# EasyEDA Pro project FOX_HTOL_1.0.eprj, board PCB1 (continued)
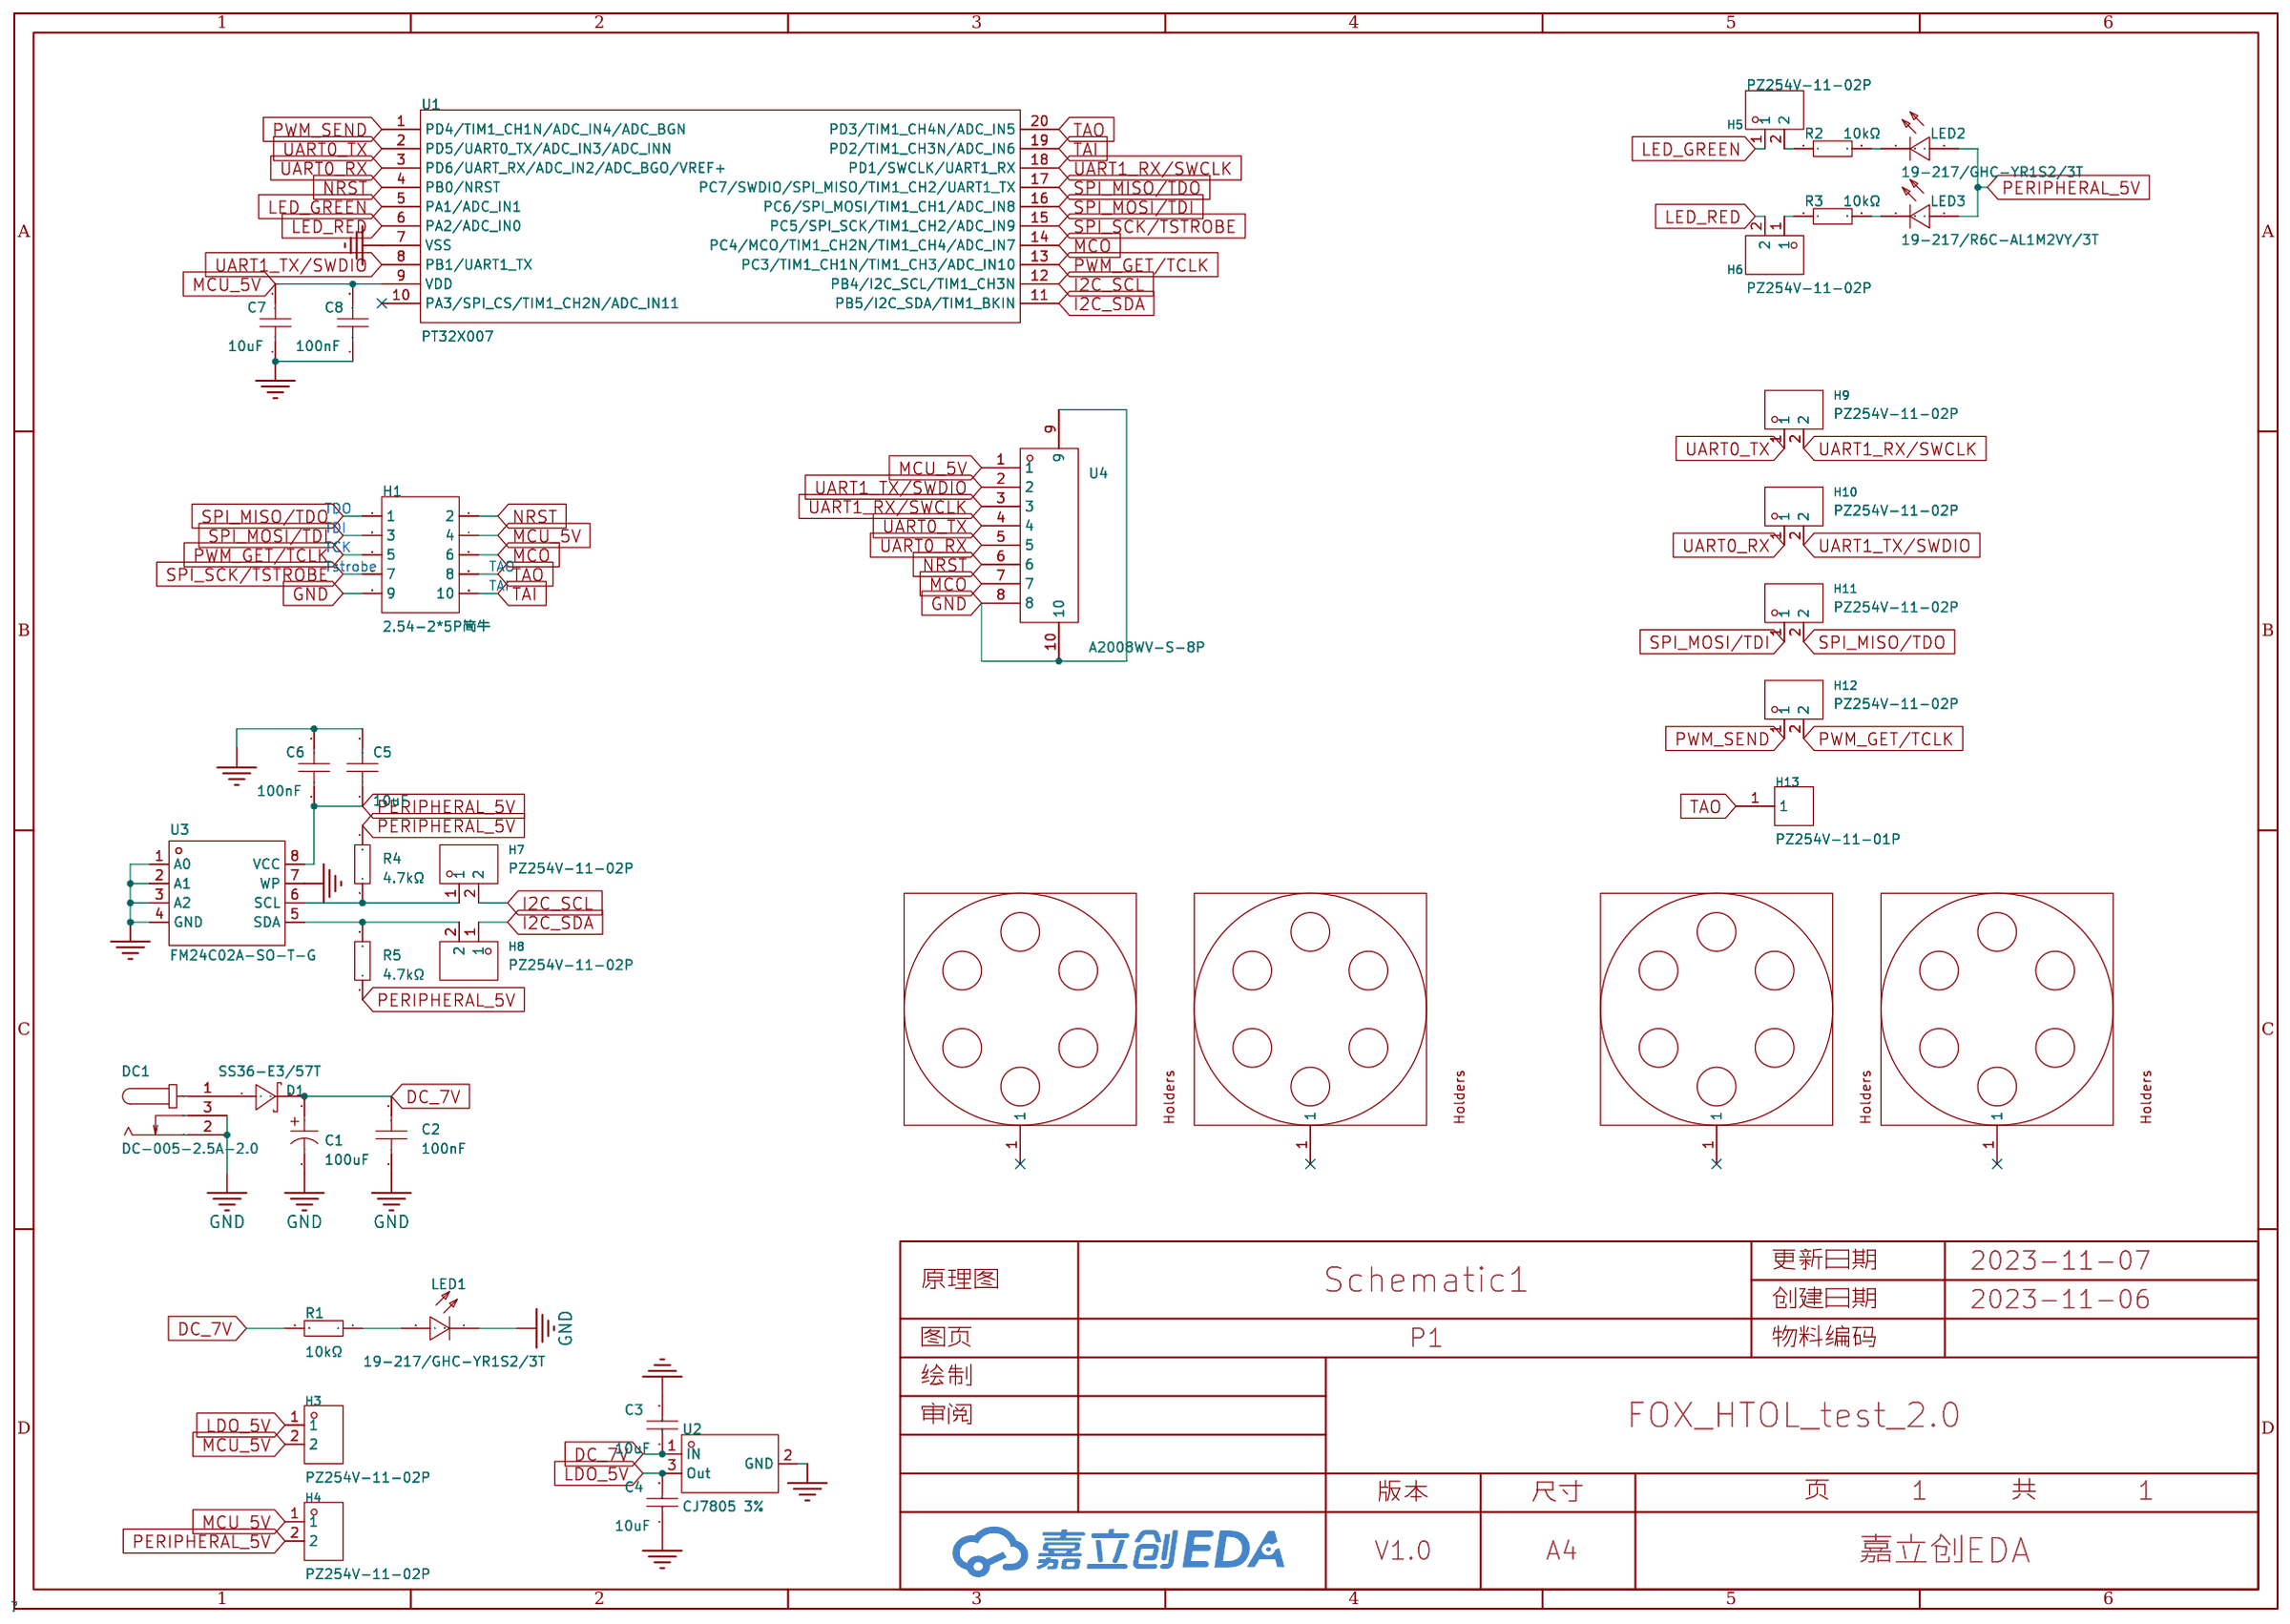
[diagram p0: schematic sheet]
## Nets (continued)
MCU_5V: C7.2 C7#2.2 C7#3.2 C7#4.2 C7#5.2 C7#6.2 C7#7.2 C7#8.2 C7#9.2 C7#10.2 C7#11.2 C7#12.2 C7#13.2 C7#14.2 C7#15.2 C7#16.2 C7#17.2 C7#18.2 C7#19.2 C7#20.2 C7#21.2 C7#22.2 C7#23.2 C7#24.2 C7#25.2 C7#26.2 C7#27.2 C7#28.2 C7#29.2 C7#30.2 C7#31.2 C7#32.2 C8.2 C8#2.2 C8#3.2 C8#4.2 C8#5.2 C8#6.2 C8#7.2 C8#8.2 C8#9.2 C8#10.2 C8#11.2 C8#12.2 C8#13.2 C8#14.2 C8#15.2 C8#16.2 C8#17.2 C8#18.2 C8#19.2 C8#20.2 C8#21.2 C8#22.2 C8#23.2 C8#24.2 C8#25.2 C8#26.2 C8#27.2 C8#28.2 C8#29.2 C8#30.2 C8#31.2 C8#32.2 H1.4 H1#2.4 H1#3.4 H1#4.4 H1#5.4 H1#6.4 H1#7.4 H1#8.4 H1#9.4 H1#10.4 H1#11.4 H1#12.4 H1#13.4 H1#14.4 H1#15.4 H1#16.4 H1#17.4 H1#18.4 H1#19.4 H1#20.4 H1#21.4 H1#22.4 H1#23.4 H1#24.4 H1#25.4 H1#26.4 H1#27.4 H1#28.4 H1#29.4 H1#30.4 H1#31.4 H1#32.4 H3.2 H3#2.2 H3#3.2 H3#4.2 H4.1 H4#2.1 H4#3.1 H4#4.1 H4#5.1 H4#6.1 H4#7.1 H4#8.1 H4#9.1 H4#10.1 H4#11.1 H4#12.1 H4#13.1 H4#14.1 H4#15.1 H4#16.1 H4#17.1 H4#18.1 H4#19.1 H4#20.1 H4#21.1 H4#22.1 H4#23.1 H4#24.1 H4#25.1 H4#26.1 H4#27.1 H4#28.1 H4#29.1 H4#30.1 H4#31.1 H4#32.1 U1.9 U1#2.9 U1#3.9 U1#4.9 U1#5.9 U1#6.9 U1#7.9 U1#8.9 U1#9.9 U1#10.9 U1#11.9 U1#12.9 U1#13.9 U1#14.9 U1#15.9 U1#16.9 U1#17.9 U1#18.9 U1#19.9 U1#20.9 U1#21.9 U1#22.9 U1#23.9 U1#24.9 U1#25.9 U1#26.9 U1#27.9 U1#28.9 U1#29.9 U1#30.9 U1#31.9 U1#32.9 U4.1 U4#2.1 U4#3.1 U4#4.1 U4#5.1 U4#6.1 U4#7.1 U4#8.1 U4#9.1 U4#10.1 U4#11.1 U4#12.1 U4#13.1 U4#14.1 U4#15.1 U4#16.1 U4#17.1 U4#18.1 U4#19.1 U4#20.1 U4#21.1 U4#22.1 U4#23.1 U4#24.1 U4#25.1 U4#26.1 U4#27.1 U4#28.1 U4#29.1 U4#30.1 U4#31.1 U4#32.1
NRST: H1.2 H1#2.2 H1#3.2 H1#4.2 H1#5.2 H1#6.2 H1#7.2 H1#8.2 H1#9.2 H1#10.2 H1#11.2 H1#12.2 H1#13.2 H1#14.2 H1#15.2 H1#16.2 H1#17.2 H1#18.2 H1#19.2 H1#20.2 H1#21.2 H1#22.2 H1#23.2 H1#24.2 H1#25.2 H1#26.2 H1#27.2 H1#28.2 H1#29.2 H1#30.2 H1#31.2 H1#32.2 U1.4 U1#2.4 U1#3.4 U1#4.4 U1#5.4 U1#6.4 U1#7.4 U1#8.4 U1#9.4 U1#10.4 U1#11.4 U1#12.4 U1#13.4 U1#14.4 U1#15.4 U1#16.4 U1#17.4 U1#18.4 U1#19.4 U1#20.4 U1#21.4 U1#22.4 U1#23.4 U1#24.4 U1#25.4 U1#26.4 U1#27.4 U1#28.4 U1#29.4 U1#30.4 U1#31.4 U1#32.4 U4.6 U4#2.6 U4#3.6 U4#4.6 U4#5.6 U4#6.6 U4#7.6 U4#8.6 U4#9.6 U4#10.6 U4#11.6 U4#12.6 U4#13.6 U4#14.6 U4#15.6 U4#16.6 U4#17.6 U4#18.6 U4#19.6 U4#20.6 U4#21.6 U4#22.6 U4#23.6 U4#24.6 U4#25.6 U4#26.6 U4#27.6 U4#28.6 U4#29.6 U4#30.6 U4#31.6 U4#32.6
PERIPHERAL_5V: C5.1 C5#2.1 C5#3.1 C5#4.1 C5#5.1 C5#6.1 C5#7.1 C5#8.1 C5#9.1 C5#10.1 C5#11.1 C5#12.1 C5#13.1 C5#14.1 C5#15.1 C5#16.1 C5#17.1 C5#18.1 C5#19.1 C5#20.1 C5#21.1 C5#22.1 C5#23.1 C5#24.1 C5#25.1 C5#26.1 C5#27.1 C5#28.1 C5#29.1 C5#30.1 C5#31.1 C5#32.1 C6.1 C6#2.1 C6#3.1 C6#4.1 C6#5.1 C6#6.1 C6#7.1 C6#8.1 C6#9.1 C6#10.1 C6#11.1 C6#12.1 C6#13.1 C6#14.1 C6#15.1 C6#16.1 C6#17.1 C6#18.1 C6#19.1 C6#20.1 C6#21.1 C6#22.1 C6#23.1 C6#24.1 C6#25.1 C6#26.1 C6#27.1 C6#28.1 C6#29.1 C6#30.1 C6#31.1 C6#32.1 H4.2 H4#2.2 H4#3.2 H4#4.2 H4#5.2 H4#6.2 H4#7.2 H4#8.2 H4#9.2 H4#10.2 H4#11.2 H4#12.2 H4#13.2 H4#14.2 H4#15.2 H4#16.2 H4#17.2 H4#18.2 H4#19.2 H4#20.2 H4#21.2 H4#22.2 H4#23.2 H4#24.2 H4#25.2 H4#26.2 H4#27.2 H4#28.2 H4#29.2 H4#30.2 H4#31.2 H4#32.2 LED2.2 LED2#2.2 LED2#3.2 LED2#4.2 LED2#5.2 LED2#6.2 LED2#7.2 LED2#8.2 LED2#9.2 LED2#10.2 LED2#11.2 LED2#12.2 LED2#13.2 LED2#14.2 LED2#15.2 LED2#16.2 LED2#17.2 LED2#18.2 LED2#19.2 LED2#20.2 LED2#21.2 LED2#22.2 LED2#23.2 LED2#24.2 LED2#25.2 LED2#26.2 LED2#27.2 LED2#28.2 LED2#29.2 LED2#30.2 LED2#31.2 LED2#32.2 LED3.2 LED3#2.2 LED3#3.2 LED3#4.2 LED3#5.2 LED3#6.2 LED3#7.2 LED3#8.2 LED3#9.2 LED3#10.2 LED3#11.2 LED3#12.2 LED3#13.2 LED3#14.2 LED3#15.2 LED3#16.2 LED3#17.2 LED3#18.2 LED3#19.2 LED3#20.2 LED3#21.2 LED3#22.2 LED3#23.2 LED3#24.2 LED3#25.2 LED3#26.2 LED3#27.2 LED3#28.2 LED3#29.2 LED3#30.2 LED3#31.2 LED3#32.2 R4.2 R4#2.2 R4#3.2 R4#4.2 R4#5.2 R4#6.2 R4#7.2 R4#8.2 R4#9.2 R4#10.2 R4#11.2 R4#12.2 R4#13.2 R4#14.2 R4#15.2 R4#16.2 R4#17.2 R4#18.2 R4#19.2 R4#20.2 R4#21.2 R4#22.2 R4#23.2 R4#24.2 R4#25.2 R4#26.2 R4#27.2 R4#28.2 R4#29.2 R4#30.2 R4#31.2 R4#32.2 R5.1 R5#2.1 R5#3.1 R5#4.1 R5#5.1 R5#6.1 R5#7.1 R5#8.1 R5#9.1 R5#10.1 R5#11.1 R5#12.1 R5#13.1 R5#14.1 R5#15.1 R5#16.1 R5#17.1 R5#18.1 R5#19.1 R5#20.1 R5#21.1 R5#22.1 R5#23.1 R5#24.1 R5#25.1 R5#26.1 R5#27.1 R5#28.1 R5#29.1 R5#30.1 R5#31.1 R5#32.1 U3.8 U3#2.8 U3#3.8 U3#4.8 U3#5.8 U3#6.8 U3#7.8 U3#8.8 U3#9.8 U3#10.8 U3#11.8 U3#12.8 U3#13.8 U3#14.8 U3#15.8 U3#16.8 U3#17.8 U3#18.8 U3#19.8 U3#20.8 U3#21.8 U3#22.8 U3#23.8 U3#24.8 U3#25.8 U3#26.8 U3#27.8 U3#28.8 U3#29.8 U3#30.8 U3#31.8 U3#32.8
PWM_GET/TCLK: H1.5 H1#2.5 H1#3.5 H1#4.5 H1#5.5 H1#6.5 H1#7.5 H1#8.5 H1#9.5 H1#10.5 H1#11.5 H1#12.5 H1#13.5 H1#14.5 H1#15.5 H1#16.5 H1#17.5 H1#18.5 H1#19.5 H1#20.5 H1#21.5 H1#22.5 H1#23.5 H1#24.5 H1#25.5 H1#26.5 H1#27.5 H1#28.5 H1#29.5 H1#30.5 H1#31.5 H1#32.5 H12.2 H12#2.2 H12#3.2 H12#4.2 H12#5.2 H12#6.2 H12#7.2 H12#8.2 H12#9.2 H12#10.2 H12#11.2 H12#12.2 H12#13.2 H12#14.2 H12#15.2 H12#16.2 H12#17.2 H12#18.2 H12#19.2 H12#20.2 H12#21.2 H12#22.2 H12#23.2 H12#24.2 H12#25.2 H12#26.2 H12#27.2 H12#28.2 H12#29.2 H12#30.2 H12#31.2 H12#32.2 U1.13 U1#2.13 U1#3.13 U1#4.13 U1#5.13 U1#6.13 U1#7.13 U1#8.13 U1#9.13 U1#10.13 U1#11.13 U1#12.13 U1#13.13 U1#14.13 U1#15.13 U1#16.13 U1#17.13 U1#18.13 U1#19.13 U1#20.13 U1#21.13 U1#22.13 U1#23.13 U1#24.13 U1#25.13 U1#26.13 U1#27.13 U1#28.13 U1#29.13 U1#30.13 U1#31.13 U1#32.13
PWM_SEND: H12.1 H12#2.1 H12#3.1 H12#4.1 H12#5.1 H12#6.1 H12#7.1 H12#8.1 H12#9.1 H12#10.1 H12#11.1 H12#12.1 H12#13.1 H12#14.1 H12#15.1 H12#16.1 H12#17.1 H12#18.1 H12#19.1 H12#20.1 H12#21.1 H12#22.1 H12#23.1 H12#24.1 H12#25.1 H12#26.1 H12#27.1 H12#28.1 H12#29.1 H12#30.1 H12#31.1 H12#32.1 U1.1 U1#2.1 U1#3.1 U1#4.1 U1#5.1 U1#6.1 U1#7.1 U1#8.1 U1#9.1 U1#10.1 U1#11.1 U1#12.1 U1#13.1 U1#14.1 U1#15.1 U1#16.1 U1#17.1 U1#18.1 U1#19.1 U1#20.1 U1#21.1 U1#22.1 U1#23.1 U1#24.1 U1#25.1 U1#26.1 U1#27.1 U1#28.1 U1#29.1 U1#30.1 U1#31.1 U1#32.1
SPI_MISO/TDO: H1.1 H1#2.1 H1#3.1 H1#4.1 H1#5.1 H1#6.1 H1#7.1 H1#8.1 H1#9.1 H1#10.1 H1#11.1 H1#12.1 H1#13.1 H1#14.1 H1#15.1 H1#16.1 H1#17.1 H1#18.1 H1#19.1 H1#20.1 H1#21.1 H1#22.1 H1#23.1 H1#24.1 H1#25.1 H1#26.1 H1#27.1 H1#28.1 H1#29.1 H1#30.1 H1#31.1 H1#32.1 H11.2 H11#2.2 H11#3.2 H11#4.2 H11#5.2 H11#6.2 H11#7.2 H11#8.2 H11#9.2 H11#10.2 H11#11.2 H11#12.2 H11#13.2 H11#14.2 H11#15.2 H11#16.2 H11#17.2 H11#18.2 H11#19.2 H11#20.2 H11#21.2 H11#22.2 H11#23.2 H11#24.2 H11#25.2 H11#26.2 H11#27.2 H11#28.2 H11#29.2 H11#30.2 H11#31.2 H11#32.2 U1.17 U1#2.17 U1#3.17 U1#4.17 U1#5.17 U1#6.17 U1#7.17 U1#8.17 U1#9.17 U1#10.17 U1#11.17 U1#12.17 U1#13.17 U1#14.17 U1#15.17 U1#16.17 U1#17.17 U1#18.17 U1#19.17 U1#20.17 U1#21.17 U1#22.17 U1#23.17 U1#24.17 U1#25.17 U1#26.17 U1#27.17 U1#28.17 U1#29.17 U1#30.17 U1#31.17 U1#32.17
SPI_MOSI/TDI: H1.3 H1#2.3 H1#3.3 H1#4.3 H1#5.3 H1#6.3 H1#7.3 H1#8.3 H1#9.3 H1#10.3 H1#11.3 H1#12.3 H1#13.3 H1#14.3 H1#15.3 H1#16.3 H1#17.3 H1#18.3 H1#19.3 H1#20.3 H1#21.3 H1#22.3 H1#23.3 H1#24.3 H1#25.3 H1#26.3 H1#27.3 H1#28.3 H1#29.3 H1#30.3 H1#31.3 H1#32.3 H11.1 H11#2.1 H11#3.1 H11#4.1 H11#5.1 H11#6.1 H11#7.1 H11#8.1 H11#9.1 H11#10.1 H11#11.1 H11#12.1 H11#13.1 H11#14.1 H11#15.1 H11#16.1 H11#17.1 H11#18.1 H11#19.1 H11#20.1 H11#21.1 H11#22.1 H11#23.1 H11#24.1 H11#25.1 H11#26.1 H11#27.1 H11#28.1 H11#29.1 H11#30.1 H11#31.1 H11#32.1 U1.16 U1#2.16 U1#3.16 U1#4.16 U1#5.16 U1#6.16 U1#7.16 U1#8.16 U1#9.16 U1#10.16 U1#11.16 U1#12.16 U1#13.16 U1#14.16 U1#15.16 U1#16.16 U1#17.16 U1#18.16 U1#19.16 U1#20.16 U1#21.16 U1#22.16 U1#23.16 U1#24.16 U1#25.16 U1#26.16 U1#27.16 U1#28.16 U1#29.16 U1#30.16 U1#31.16 U1#32.16
SPI_SCK/TSTROBE: H1.7 H1#2.7 H1#3.7 H1#4.7 H1#5.7 H1#6.7 H1#7.7 H1#8.7 H1#9.7 H1#10.7 H1#11.7 H1#12.7 H1#13.7 H1#14.7 H1#15.7 H1#16.7 H1#17.7 H1#18.7 H1#19.7 H1#20.7 H1#21.7 H1#22.7 H1#23.7 H1#24.7 H1#25.7 H1#26.7 H1#27.7 H1#28.7 H1#29.7 H1#30.7 H1#31.7 H1#32.7 U1.15 U1#2.15 U1#3.15 U1#4.15 U1#5.15 U1#6.15 U1#7.15 U1#8.15 U1#9.15 U1#10.15 U1#11.15 U1#12.15 U1#13.15 U1#14.15 U1#15.15 U1#16.15 U1#17.15 U1#18.15 U1#19.15 U1#20.15 U1#21.15 U1#22.15 U1#23.15 U1#24.15 U1#25.15 U1#26.15 U1#27.15 U1#28.15 U1#29.15 U1#30.15 U1#31.15 U1#32.15
TAI: H1.10 H1#2.10 H1#3.10 H1#4.10 H1#5.10 H1#6.10 H1#7.10 H1#8.10 H1#9.10 H1#10.10 H1#11.10 H1#12.10 H1#13.10 H1#14.10 H1#15.10 H1#16.10 H1#17.10 H1#18.10 H1#19.10 H1#20.10 H1#21.10 H1#22.10 H1#23.10 H1#24.10 H1#25.10 H1#26.10 H1#27.10 H1#28.10 H1#29.10 H1#30.10 H1#31.10 H1#32.10 U1.19 U1#2.19 U1#3.19 U1#4.19 U1#5.19 U1#6.19 U1#7.19 U1#8.19 U1#9.19 U1#10.19 U1#11.19 U1#12.19 U1#13.19 U1#14.19 U1#15.19 U1#16.19 U1#17.19 U1#18.19 U1#19.19 U1#20.19 U1#21.19 U1#22.19 U1#23.19 U1#24.19 U1#25.19 U1#26.19 U1#27.19 U1#28.19 U1#29.19 U1#30.19 U1#31.19 U1#32.19
TAO: H1.8 H1#2.8 H1#3.8 H1#4.8 H1#5.8 H1#6.8 H1#7.8 H1#8.8 H1#9.8 H1#10.8 H1#11.8 H1#12.8 H1#13.8 H1#14.8 H1#15.8 H1#16.8 H1#17.8 H1#18.8 H1#19.8 H1#20.8 H1#21.8 H1#22.8 H1#23.8 H1#24.8 H1#25.8 H1#26.8 H1#27.8 H1#28.8 H1#29.8 H1#30.8 H1#31.8 H1#32.8 H13.1 H13#2.1 H13#3.1 H13#4.1 H13#5.1 H13#6.1 H13#7.1 H13#8.1 H13#9.1 H13#10.1 H13#11.1 H13#12.1 H13#13.1 H13#14.1 H13#15.1 H13#16.1 H13#17.1 H13#18.1 H13#19.1 H13#20.1 H13#21.1 H13#22.1 H13#23.1 H13#24.1 H13#25.1 H13#26.1 H13#27.1 H13#28.1 H13#29.1 H13#30.1 H13#31.1 H13#32.1 U1.20 U1#2.20 U1#3.20 U1#4.20 U1#5.20 U1#6.20 U1#7.20 U1#8.20 U1#9.20 U1#10.20 U1#11.20 U1#12.20 U1#13.20 U1#14.20 U1#15.20 U1#16.20 U1#17.20 U1#18.20 U1#19.20 U1#20.20 U1#21.20 U1#22.20 U1#23.20 U1#24.20 U1#25.20 U1#26.20 U1#27.20 U1#28.20 U1#29.20 U1#30.20 U1#31.20 U1#32.20
UART0_RX: H10.1 H10#2.1 H10#3.1 H10#4.1 H10#5.1 H10#6.1 H10#7.1 H10#8.1 H10#9.1 H10#10.1 H10#11.1 H10#12.1 H10#13.1 H10#14.1 H10#15.1 H10#16.1 H10#17.1 H10#18.1 H10#19.1 H10#20.1 H10#21.1 H10#22.1 H10#23.1 H10#24.1 H10#25.1 H10#26.1 H10#27.1 H10#28.1 H10#29.1 H10#30.1 H10#31.1 H10#32.1 U1.3 U1#2.3 U1#3.3 U1#4.3 U1#5.3 U1#6.3 U1#7.3 U1#8.3 U1#9.3 U1#10.3 U1#11.3 U1#12.3 U1#13.3 U1#14.3 U1#15.3 U1#16.3 U1#17.3 U1#18.3 U1#19.3 U1#20.3 U1#21.3 U1#22.3 U1#23.3 U1#24.3 U1#25.3 U1#26.3 U1#27.3 U1#28.3 U1#29.3 U1#30.3 U1#31.3 U1#32.3 U4.5 U4#2.5 U4#3.5 U4#4.5 U4#5.5 U4#6.5 U4#7.5 U4#8.5 U4#9.5 U4#10.5 U4#11.5 U4#12.5 U4#13.5 U4#14.5 U4#15.5 U4#16.5 U4#17.5 U4#18.5 U4#19.5 U4#20.5 U4#21.5 U4#22.5 U4#23.5 U4#24.5 U4#25.5 U4#26.5 U4#27.5 U4#28.5 U4#29.5 U4#30.5 U4#31.5 U4#32.5
UART0_TX: H9.1 H9#2.1 H9#3.1 H9#4.1 H9#5.1 H9#6.1 H9#7.1 H9#8.1 H9#9.1 H9#10.1 H9#11.1 H9#12.1 H9#13.1 H9#14.1 H9#15.1 H9#16.1 H9#17.1 H9#18.1 H9#19.1 H9#20.1 H9#21.1 H9#22.1 H9#23.1 H9#24.1 H9#25.1 H9#26.1 H9#27.1 H9#28.1 H9#29.1 H9#30.1 H9#31.1 H9#32.1 U1.2 U1#2.2 U1#3.2 U1#4.2 U1#5.2 U1#6.2 U1#7.2 U1#8.2 U1#9.2 U1#10.2 U1#11.2 U1#12.2 U1#13.2 U1#14.2 U1#15.2 U1#16.2 U1#17.2 U1#18.2 U1#19.2 U1#20.2 U1#21.2 U1#22.2 U1#23.2 U1#24.2 U1#25.2 U1#26.2 U1#27.2 U1#28.2 U1#29.2 U1#30.2 U1#31.2 U1#32.2 U4.4 U4#2.4 U4#3.4 U4#4.4 U4#5.4 U4#6.4 U4#7.4 U4#8.4 U4#9.4 U4#10.4 U4#11.4 U4#12.4 U4#13.4 U4#14.4 U4#15.4 U4#16.4 U4#17.4 U4#18.4 U4#19.4 U4#20.4 U4#21.4 U4#22.4 U4#23.4 U4#24.4 U4#25.4 U4#26.4 U4#27.4 U4#28.4 U4#29.4 U4#30.4 U4#31.4 U4#32.4
UART1_RX/SWCLK: H9.2 H9#2.2 H9#3.2 H9#4.2 H9#5.2 H9#6.2 H9#7.2 H9#8.2 H9#9.2 H9#10.2 H9#11.2 H9#12.2 H9#13.2 H9#14.2 H9#15.2 H9#16.2 H9#17.2 H9#18.2 H9#19.2 H9#20.2 H9#21.2 H9#22.2 H9#23.2 H9#24.2 H9#25.2 H9#26.2 H9#27.2 H9#28.2 H9#29.2 H9#30.2 H9#31.2 H9#32.2 U1.18 U1#2.18 U1#3.18 U1#4.18 U1#5.18 U1#6.18 U1#7.18 U1#8.18 U1#9.18 U1#10.18 U1#11.18 U1#12.18 U1#13.18 U1#14.18 U1#15.18 U1#16.18 U1#17.18 U1#18.18 U1#19.18 U1#20.18 U1#21.18 U1#22.18 U1#23.18 U1#24.18 U1#25.18 U1#26.18 U1#27.18 U1#28.18 U1#29.18 U1#30.18 U1#31.18 U1#32.18 U4.3 U4#2.3 U4#3.3 U4#4.3 U4#5.3 U4#6.3 U4#7.3 U4#8.3 U4#9.3 U4#10.3 U4#11.3 U4#12.3 U4#13.3 U4#14.3 U4#15.3 U4#16.3 U4#17.3 U4#18.3 U4#19.3 U4#20.3 U4#21.3 U4#22.3 U4#23.3 U4#24.3 U4#25.3 U4#26.3 U4#27.3 U4#28.3 U4#29.3 U4#30.3 U4#31.3 U4#32.3
UART1_TX/SWDIO: H10.2 H10#2.2 H10#3.2 H10#4.2 H10#5.2 H10#6.2 H10#7.2 H10#8.2 H10#9.2 H10#10.2 H10#11.2 H10#12.2 H10#13.2 H10#14.2 H10#15.2 H10#16.2 H10#17.2 H10#18.2 H10#19.2 H10#20.2 H10#21.2 H10#22.2 H10#23.2 H10#24.2 H10#25.2 H10#26.2 H10#27.2 H10#28.2 H10#29.2 H10#30.2 H10#31.2 H10#32.2 U1.8 U1#2.8 U1#3.8 U1#4.8 U1#5.8 U1#6.8 U1#7.8 U1#8.8 U1#9.8 U1#10.8 U1#11.8 U1#12.8 U1#13.8 U1#14.8 U1#15.8 U1#16.8 U1#17.8 U1#18.8 U1#19.8 U1#20.8 U1#21.8 U1#22.8 U1#23.8 U1#24.8 U1#25.8 U1#26.8 U1#27.8 U1#28.8 U1#29.8 U1#30.8 U1#31.8 U1#32.8 U4.2 U4#2.2 U4#3.2 U4#4.2 U4#5.2 U4#6.2 U4#7.2 U4#8.2 U4#9.2 U4#10.2 U4#11.2 U4#12.2 U4#13.2 U4#14.2 U4#15.2 U4#16.2 U4#17.2 U4#18.2 U4#19.2 U4#20.2 U4#21.2 U4#22.2 U4#23.2 U4#24.2 U4#25.2 U4#26.2 U4#27.2 U4#28.2 U4#29.2 U4#30.2 U4#31.2 U4#32.2
$1N831: D1.1 DC1.1
$1N1246: LED1.2 R1.1
$1N1959: H5.2 H5#2.2 H5#3.2 H5#4.2 H5#5.2 H5#6.2 H5#7.2 H5#8.2 H5#9.2 H5#10.2 H5#11.2 H5#12.2 H5#13.2 H5#14.2 H5#15.2 H5#16.2 H5#17.2 H5#18.2 H5#19.2 H5#20.2 H5#21.2 H5#22.2 H5#23.2 H5#24.2 H5#25.2 H5#26.2 H5#27.2 H5#28.2 H5#29.2 H5#30.2 H5#31.2 H5#32.2 R2.1 R2#2.1 R2#3.1 R2#4.1 R2#5.1 R2#6.1 R2#7.1 R2#8.1 R2#9.1 R2#10.1 R2#11.1 R2#12.1 R2#13.1 R2#14.1 R2#15.1 R2#16.1 R2#17.1 R2#18.1 R2#19.1 R2#20.1 R2#21.1 R2#22.1 R2#23.1 R2#24.1 R2#25.1 R2#26.1 R2#27.1 R2#28.1 R2#29.1 R2#30.1 R2#31.1 R2#32.1
$1N1962: H6.1 H6#2.1 H6#3.1 H6#4.1 H6#5.1 H6#6.1 H6#7.1 H6#8.1 H6#9.1 H6#10.1 H6#11.1 H6#12.1 H6#13.1 H6#14.1 H6#15.1 H6#16.1 H6#17.1 H6#18.1 H6#19.1 H6#20.1 H6#21.1 H6#22.1 H6#23.1 H6#24.1 H6#25.1 H6#26.1 H6#27.1 H6#28.1 H6#29.1 H6#30.1 H6#31.1 H6#32.1 R3.1 R3#2.1 R3#3.1 R3#4.1 R3#5.1 R3#6.1 R3#7.1 R3#8.1 R3#9.1 R3#10.1 R3#11.1 R3#12.1 R3#13.1 R3#14.1 R3#15.1 R3#16.1 R3#17.1 R3#18.1 R3#19.1 R3#20.1 R3#21.1 R3#22.1 R3#23.1 R3#24.1 R3#25.1 R3#26.1 R3#27.1 R3#28.1 R3#29.1 R3#30.1 R3#31.1 R3#32.1
$1N1965: LED2.1 LED2#2.1 LED2#3.1 LED2#4.1 LED2#5.1 LED2#6.1 LED2#7.1 LED2#8.1 LED2#9.1 LED2#10.1 LED2#11.1 LED2#12.1 LED2#13.1 LED2#14.1 LED2#15.1 LED2#16.1 LED2#17.1 LED2#18.1 LED2#19.1 LED2#20.1 LED2#21.1 LED2#22.1 LED2#23.1 LED2#24.1 LED2#25.1 LED2#26.1 LED2#27.1 LED2#28.1 LED2#29.1 LED2#30.1 LED2#31.1 LED2#32.1 R2.2 R2#2.2 R2#3.2 R2#4.2 R2#5.2 R2#6.2 R2#7.2 R2#8.2 R2#9.2 R2#10.2 R2#11.2 R2#12.2 R2#13.2 R2#14.2 R2#15.2 R2#16.2 R2#17.2 R2#18.2 R2#19.2 R2#20.2 R2#21.2 R2#22.2 R2#23.2 R2#24.2 R2#25.2 R2#26.2 R2#27.2 R2#28.2 R2#29.2 R2#30.2 R2#31.2 R2#32.2
$1N1968: LED3.1 LED3#2.1 LED3#3.1 LED3#4.1 LED3#5.1 LED3#6.1 LED3#7.1 LED3#8.1 LED3#9.1 LED3#10.1 LED3#11.1 LED3#12.1 LED3#13.1 LED3#14.1 LED3#15.1 LED3#16.1 LED3#17.1 LED3#18.1 LED3#19.1 LED3#20.1 LED3#21.1 LED3#22.1 LED3#23.1 LED3#24.1 LED3#25.1 LED3#26.1 LED3#27.1 LED3#28.1 LED3#29.1 LED3#30.1 LED3#31.1 LED3#32.1 R3.2 R3#2.2 R3#3.2 R3#4.2 R3#5.2 R3#6.2 R3#7.2 R3#8.2 R3#9.2 R3#10.2 R3#11.2 R3#12.2 R3#13.2 R3#14.2 R3#15.2 R3#16.2 R3#17.2 R3#18.2 R3#19.2 R3#20.2 R3#21.2 R3#22.2 R3#23.2 R3#24.2 R3#25.2 R3#26.2 R3#27.2 R3#28.2 R3#29.2 R3#30.2 R3#31.2 R3#32.2
$1N2989: H7.1 H7#2.1 H7#3.1 H7#4.1 H7#5.1 H7#6.1 H7#7.1 H7#8.1 H7#9.1 H7#10.1 H7#11.1 H7#12.1 H7#13.1 H7#14.1 H7#15.1 H7#16.1 H7#17.1 H7#18.1 H7#19.1 H7#20.1 H7#21.1 H7#22.1 H7#23.1 H7#24.1 H7#25.1 H7#26.1 H7#27.1 H7#28.1 H7#29.1 H7#30.1 H7#31.1 H7#32.1 R4.1 R4#2.1 R4#3.1 R4#4.1 R4#5.1 R4#6.1 R4#7.1 R4#8.1 R4#9.1 R4#10.1 R4#11.1 R4#12.1 R4#13.1 R4#14.1 R4#15.1 R4#16.1 R4#17.1 R4#18.1 R4#19.1 R4#20.1 R4#21.1 R4#22.1 R4#23.1 R4#24.1 R4#25.1 R4#26.1 R4#27.1 R4#28.1 R4#29.1 R4#30.1 R4#31.1 R4#32.1 U3.6 U3#2.6 U3#3.6 U3#4.6 U3#5.6 U3#6.6 U3#7.6 U3#8.6 U3#9.6 U3#10.6 U3#11.6 U3#12.6 U3#13.6 U3#14.6 U3#15.6 U3#16.6 U3#17.6 U3#18.6 U3#19.6 U3#20.6 U3#21.6 U3#22.6 U3#23.6 U3#24.6 U3#25.6 U3#26.6 U3#27.6 U3#28.6 U3#29.6 U3#30.6 U3#31.6 U3#32.6
$1N3006: H8.2 H8#2.2 H8#3.2 H8#4.2 H8#5.2 H8#6.2 H8#7.2 H8#8.2 H8#9.2 H8#10.2 H8#11.2 H8#12.2 H8#13.2 H8#14.2 H8#15.2 H8#16.2 H8#17.2 H8#18.2 H8#19.2 H8#20.2 H8#21.2 H8#22.2 H8#23.2 H8#24.2 H8#25.2 H8#26.2 H8#27.2 H8#28.2 H8#29.2 H8#30.2 H8#31.2 H8#32.2 R5.2 R5#2.2 R5#3.2 R5#4.2 R5#5.2 R5#6.2 R5#7.2 R5#8.2 R5#9.2 R5#10.2 R5#11.2 R5#12.2 R5#13.2 R5#14.2 R5#15.2 R5#16.2 R5#17.2 R5#18.2 R5#19.2 R5#20.2 R5#21.2 R5#22.2 R5#23.2 R5#24.2 R5#25.2 R5#26.2 R5#27.2 R5#28.2 R5#29.2 R5#30.2 R5#31.2 R5#32.2 U3.5 U3#2.5 U3#3.5 U3#4.5 U3#5.5 U3#6.5 U3#7.5 U3#8.5 U3#9.5 U3#10.5 U3#11.5 U3#12.5 U3#13.5 U3#14.5 U3#15.5 U3#16.5 U3#17.5 U3#18.5 U3#19.5 U3#20.5 U3#21.5 U3#22.5 U3#23.5 U3#24.5 U3#25.5 U3#26.5 U3#27.5 U3#28.5 U3#29.5 U3#30.5 U3#31.5 U3#32.5

Pads without a net: J2 1; J3 1; J4 1; J5 1; U1 10; U1#2 10; U1#3 10; U1#4 10; U1#5 10; U1#6 10; U1#7 10; U1#8 10; U1#9 10; U1#10 10; U1#11 10; U1#12 10; U1#13 10; U1#14 10; U1#15 10; U1#16 10; U1#17 10; U1#18 10; U1#19 10; U1#20 10; U1#21 10; U1#22 10; U1#23 10; U1#24 10; U1#25 10; U1#26 10; U1#27 10; U1#28 10; U1#29 10; U1#30 10; U1#31 10; U1#32 10

## Via types
v1: diameter 0.61, hole 0.305, Top Layer to Bottom Layer, 480 vias
v2: diameter 0.51, hole 0.305, Top Layer to Bottom Layer, 192 vias
v3: diameter 0.81, hole 0.51, Top Layer to Bottom Layer, 64 vias

## Routing (per net, layer and track width the routed paths; a pad name or vN(x,y) marks a point on that pad's centre or on a via; arc(x,y) is an arc through that point)
GND:
  vias: v1(12.85,240.66) v1(12.85,239.39) v1(12.85,208.54) v1(12.85,207.27) v1(12.85,176.42) v1(12.85,175.15) v1(12.85,144.29) v1(12.85,143.02) v1(12.85,112.17) v1(12.85,110.9) v1(12.85,80.04) v1(12.85,78.77) v1(12.85,47.92) v1(12.85,46.65) v1(12.85,15.79) v1(12.85,14.52) v1(13.84,247.08) v1(13.84,214.96) v1(13.84,182.83) v1(13.84,150.71) v1(13.84,118.58) v1(13.84,86.46) v1(13.84,54.33) v1(13.84,22.21) v1(15.49,247.08) v1(15.49,214.96) v1(15.49,182.83) v1(15.49,150.71) v1(15.49,118.58) v1(15.49,86.46) v1(15.49,54.33) v1(15.49,22.21) v1(18.65,240.66) v1(18.65,208.54) v1(18.65,176.42) v1(18.65,144.29) v1(18.65,112.17) v1(18.65,80.04) v1(18.65,47.92) v1(18.65,15.79) v1(35.11,261.16) v1(35.11,229.04) v1(35.11,196.91) v1(35.11,164.79) v1(35.11,132.66) v1(35.11,100.54) v1(35.11,68.42) v1(35.11,36.29) v1(51.26,240.66) v1(51.26,239.39) v1(51.26,208.54) v1(51.26,207.27) v1(51.26,176.42) v1(51.26,175.15) v1(51.26,144.29) v1(51.26,143.02) v1(51.26,112.17) v1(51.26,110.9) v1(51.26,80.04) v1(51.26,78.77) v1(51.26,47.92) v1(51.26,46.65) v1(51.26,15.79) v1(51.26,14.52) v1(52.26,247.08) v1(52.26,214.96) v1(52.26,182.83) v1(52.26,150.71) v1(52.26,118.58) v1(52.26,86.46) v1(52.26,54.33) v1(52.26,22.21) v1(53.91,247.08) v1(53.91,214.96) v1(53.91,182.83) v1(53.91,150.71) v1(53.91,118.58) v1(53.91,86.46) v1(53.91,54.33) v1(53.91,22.21) v1(57.06,240.66) v1(57.06,208.54) v1(57.06,176.42) v1(57.06,144.29) v1(57.06,112.17) v1(57.06,80.04) v1(57.06,47.92) v1(57.06,15.79) v1(73.52,261.16) v1(73.52,229.04) v1(73.52,196.91) v1(73.52,164.79) v1(73.52,132.66) v1(73.52,100.54) v1(73.52,68.42) v1(73.52,36.29) v1(89.68,240.66) v1(89.68,239.39) v1(89.68,208.54) v1(89.68,207.27) v1(89.68,176.42) v1(89.68,175.15) v1(89.68,144.29) v1(89.68,143.02) v1(89.68,112.17) v1(89.68,110.9) v1(89.68,80.04) v1(89.68,78.77) v1(89.68,47.92) v1(89.68,46.65) v1(89.68,15.79) v1(89.68,14.52) v1(90.68,247.08) v1(90.68,214.96) v1(90.68,182.83) v1(90.68,150.71) v1(90.68,118.58) v1(90.68,86.46) v1(90.68,54.33) v1(90.68,22.21) v1(92.33,247.08) v1(92.33,214.96) v1(92.33,182.83) v1(92.33,150.71) v1(92.33,118.58) v1(92.33,86.46) v1(92.33,54.33) v1(92.33,22.21) v1(95.48,240.66) v1(95.48,208.54) v1(95.48,176.42) v1(95.48,144.29) v1(95.48,112.17) v1(95.48,80.04) v1(95.48,47.92) v1(95.48,15.79) v1(111.94,261.16) v1(111.94,229.04) v1(111.94,196.91) v1(111.94,164.79) v1(111.94,132.66) v1(111.94,100.54) v1(111.94,68.42) v1(111.94,36.29) v1(128.1,240.66) v1(128.1,239.39) v1(128.1,208.54) v1(128.1,207.27) v1(128.1,176.42) v1(128.1,175.15) v1(128.1,144.29) v1(128.1,143.02) v1(128.1,112.17) v1(128.1,110.9) v1(128.1,80.04) v1(128.1,78.77) v1(128.1,47.92) v1(128.1,46.65) v1(128.1,15.79) v1(128.1,14.52) v1(129.09,247.08) v1(129.09,214.96) v1(129.09,182.83) v1(129.09,150.71) v1(129.09,118.58) v1(129.09,86.46) v1(129.09,54.33) v1(129.09,22.21) v1(130.74,247.08) v1(130.74,214.96) v1(130.74,182.83) v1(130.74,150.71) v1(130.74,118.58) v1(130.74,86.46) v1(130.74,54.33) v1(130.74,22.21) v1(133.9,240.66) v1(133.9,208.54) v1(133.9,176.42) v1(133.9,144.29) v1(133.9,112.17) v1(133.9,80.04) v1(133.9,47.92) v1(133.9,15.79) v1(150.35,261.16) v1(150.35,229.04) v1(150.35,196.91) v1(150.35,164.79) v1(150.35,132.66) v1(150.35,100.54) v1(150.35,68.42) v1(150.35,36.29)
DC_7V: length 11.3
  Top Layer w0.5: R1.2 34.79,283.21 D1.2
  Top Layer w1: D1.2 30.61,276.1 C1.1
I2C_SCL: length 694.5
  Top Layer w0.254: H7#23.2 9.02,113.95 9.53,113.95 10.92,115.34 25.91,115.34 26.16,115.6 26.16,116.87 25.64,117.39 U1#22.12 ; U1#17.12 140.89,149.51 141.41,148.99 141.41,147.72 141.16,147.47 126.17,147.47 124.77,146.07 124.26,146.07 H7#11.2 ; H7#28.2 47.43,49.7 47.94,49.7 49.34,51.09 64.32,51.09 64.58,51.35 64.58,52.62 64.06,53.14 U1#25.12 ; U1#9.12 102.47,149.51 102.99,148.99 102.99,147.72 102.74,147.47 87.75,147.47 86.36,146.07 85.85,146.07 H7#2.2 ; H7#12.2 124.26,113.95 124.77,113.95 126.17,115.34 141.16,115.34 141.41,115.6 141.41,116.87 140.89,117.39 U1#10.12 ; H7#10.2 124.26,17.57 124.77,17.57 126.17,18.97 141.16,18.97 141.41,19.22 141.41,20.49 140.89,21.01 U1#12.12 ; H7#8.2 85.85,210.32 86.36,210.32 87.75,211.72 102.74,211.72 102.99,211.97 102.99,213.24 102.47,213.76 U1#5.12 ; H7#32.2 47.43,178.19 47.94,178.19 49.34,179.59 64.32,179.59 64.58,179.84 64.58,181.11 64.06,181.63 U1#30.12 ; H7#17.2 124.26,210.32 124.77,210.32 126.17,211.72 141.16,211.72 141.41,211.97 141.41,213.24 140.89,213.76 U1#13.12 ; U1#21.12 25.64,53.14 26.16,52.62 26.16,51.35 25.91,51.09 10.92,51.09 9.53,49.7 9.02,49.7 H7#22.2 ; H7#4.2 85.85,49.7 86.36,49.7 87.75,51.09 102.74,51.09 102.99,51.35 102.99,52.62 102.47,53.14 U1#3.12 ; U1#31.12 25.64,181.63 26.16,181.11 26.16,179.84 25.91,179.59 10.92,179.59 9.53,178.19 9.02,178.19 H7#16.2 ; H7#27.2 47.43,113.95 47.94,113.95 49.34,115.34 64.32,115.34 64.58,115.6 64.58,116.87 64.06,117.39 U1#24.12 ; 23.95,85.26 25.64,85.26 26.16,84.74 26.16,83.47 25.91,83.22 10.92,83.22 9.53,81.82 9.02,81.82 H7#21.2 ; U1#11.12 140.89,53.14 141.41,52.62 141.41,51.35 141.16,51.09 126.17,51.09 124.77,49.7 124.26,49.7 H7#13.2 ; H7.2 85.85,17.57 86.36,17.57 87.75,18.97 102.74,18.97 102.99,19.22 102.99,20.49 102.47,21.01 U1#4.12 ; H7#5.2 85.85,81.82 86.36,81.82 87.75,83.22 102.74,83.22 102.99,83.47 102.99,84.74 102.47,85.26 100.78,85.26 ; H7#3.2 85.85,113.95 86.36,113.95 87.75,115.34 102.74,115.34 102.99,115.6 102.99,116.87 102.47,117.39 U1#2.12 ; U1#15.12 140.89,245.88 141.41,245.36 141.41,244.09 141.16,243.84 126.17,243.84 124.77,242.44 124.26,242.44 H7#15.2 ; U1#29.12 64.06,245.88 64.58,245.36 64.58,244.09 64.32,243.84 49.34,243.84 47.94,242.44 47.43,242.44 H7#30.2 ; H7#24.2 9.02,210.32 9.53,210.32 10.92,211.72 25.91,211.72 26.16,211.97 26.16,213.24 25.64,213.76 U1#23.12 ; H7#29.2 47.43,81.82 47.94,81.82 49.34,83.22 64.32,83.22 64.58,83.47 64.58,84.74 64.06,85.26 62.37,85.26 ; H7#31.2 47.43,210.32 47.94,210.32 49.34,211.72 64.32,211.72 64.58,211.97 64.58,213.24 64.06,213.76 U1#27.12 ; H7#6.2 9.02,242.44 9.53,242.44 10.92,243.84 25.91,243.84 26.16,244.09 26.16,245.36 25.64,245.88 U1.12 ; H7#7.2 85.85,242.44 86.36,242.44 87.75,243.84 102.74,243.84 102.99,244.09 102.99,245.36 102.47,245.88 U1#7.12 ; H7#18.2 124.26,178.19 124.77,178.19 126.17,179.59 141.16,179.59 141.41,179.84 141.41,181.11 140.89,181.63 U1#16.12 ; H7#9.2 85.85,178.19 86.36,178.19 87.75,179.59 102.74,179.59 102.99,179.84 102.99,181.11 102.47,181.63 U1#8.12 ; H7#26.2 47.43,146.07 47.94,146.07 49.34,147.47 64.32,147.47 64.58,147.72 64.58,148.99 64.06,149.51 U1#32.12 ; H7#19.2 9.02,146.07 9.53,146.07 10.92,147.47 25.91,147.47 26.16,147.72 26.16,148.99 25.64,149.51 U1#18.12 ; 139.2,85.26 140.89,85.26 141.41,84.74 141.41,83.47 141.16,83.22 126.17,83.22 124.77,81.82 124.26,81.82 H7#14.2 ; H7#20.2 9.02,17.57 9.53,17.57 10.92,18.97 25.91,18.97 26.16,19.22 26.16,20.49 25.64,21.01 U1#19.12 ; H7#25.2 47.43,17.57 47.94,17.57 49.34,18.97 64.32,18.97 64.58,19.22 64.58,20.49 64.06,21.01 U1#26.12
I2C_SDA: length 611.7
  Top Layer w0.254: U1#11.11 140.53,52.49 140.77,52.24 140.77,51.86 140.52,51.6 127.57,51.6 126.8,52.36 H8#15.1 ; H8#27.1 49.97,212.99 50.73,212.22 63.69,212.22 63.94,212.48 63.94,212.86 63.69,213.11 U1#27.11 ; H8#13.1 126.8,148.74 127.57,147.97 140.52,147.97 140.77,148.23 140.77,148.61 140.53,148.86 U1#17.11 ; U1#15.11 140.53,245.23 140.77,244.98 140.77,244.6 140.52,244.35 127.57,244.35 126.8,245.11 H8#16.1 ; U1#30.11 63.69,180.98 63.94,180.73 63.94,180.35 63.69,180.1 50.73,180.1 49.97,180.86 H8#32.1 ; U1#12.11 140.53,20.36 140.77,20.11 140.77,19.73 140.52,19.48 127.57,19.48 126.8,20.24 H8#11.1 ; H8#30.1 49.97,52.36 50.73,51.6 63.69,51.6 63.94,51.86 63.94,52.24 63.69,52.49 U1#25.11 ; H8#18.1 126.8,180.86 127.57,180.1 140.52,180.1 140.77,180.35 140.77,180.73 140.53,180.98 U1#16.11 ; U1#3.11 102.11,52.49 102.36,52.24 102.36,51.86 102.1,51.6 89.15,51.6 88.39,52.36 H8#6.1 ; H8#26.1 49.97,20.24 50.73,19.48 63.69,19.48 63.94,19.73 63.94,20.11 63.69,20.36 U1#26.11 ; H8#12.1 126.8,212.99 127.57,212.22 140.52,212.22 140.77,212.48 140.77,212.86 140.53,213.11 U1#13.11 ; H8#22.1 11.56,52.36 12.32,51.6 25.27,51.6 25.53,51.86 25.53,52.24 25.28,52.49 U1#21.11 ; H8#23.1 11.56,116.61 12.32,115.85 25.27,115.85 25.53,116.1 25.53,116.49 25.28,116.74 U1#22.11 ; H8#31.1 49.97,245.11 50.73,244.35 63.69,244.35 63.94,244.6 63.94,244.98 63.69,245.23 U1#29.11 ; H8#24.1 11.56,212.99 12.32,212.22 25.27,212.22 25.53,212.48 25.53,212.86 25.28,213.11 U1#23.11 ; U1.11 25.28,245.23 25.53,244.98 25.53,244.6 25.27,244.35 12.32,244.35 11.56,245.11 H8#8.1 ; H8#9.1 88.39,180.86 89.15,180.1 102.1,180.1 102.36,180.35 102.36,180.73 102.11,180.98 U1#8.11 ; U1#31.11 25.28,180.98 25.53,180.73 25.53,180.35 25.27,180.1 12.32,180.1 11.56,180.86 H8#17.1 ; H8#19.1 11.56,148.74 12.32,147.97 25.27,147.97 25.53,148.23 25.53,148.61 25.28,148.86 U1#18.11 ; H8#25.1 49.97,116.61 50.73,115.85 63.69,115.85 63.94,116.1 63.94,116.49 63.69,116.74 U1#24.11 ; H8#3.1 88.39,212.99 89.15,212.22 102.1,212.22 102.36,212.48 102.36,212.86 102.11,213.11 U1#5.11 ; U1#28.11 63.69,84.61 63.94,84.36 63.94,83.98 63.69,83.73 50.73,83.73 49.97,84.49 H8#29.1 ; H8.1 88.39,116.61 89.15,115.85 102.1,115.85 102.36,116.1 102.36,116.49 102.11,116.74 U1#2.11 ; U1#32.11 63.69,148.86 63.94,148.61 63.94,148.23 63.69,147.97 50.73,147.97 49.97,148.74 H8#28.1 ; H8#2.1 88.39,20.24 89.15,19.48 102.1,19.48 102.36,19.73 102.36,20.11 102.11,20.36 U1#4.11 ; H8#5.1 88.39,84.49 89.15,83.73 102.1,83.73 102.36,83.98 102.36,84.36 102.11,84.61 U1#6.11 ; H8#21.1 11.56,84.49 12.32,83.73 25.27,83.73 25.53,83.98 25.53,84.36 25.28,84.61 U1#20.11 ; U1#19.11 25.28,20.36 25.53,20.11 25.53,19.73 25.27,19.48 12.32,19.48 11.56,20.24 H8#20.1 ; H8#7.1 88.39,245.11 89.15,244.35 102.1,244.35 102.36,244.6 102.36,244.98 102.11,245.23 U1#7.11 ; H8#10.1 126.8,116.61 127.57,115.85 140.52,115.85 140.77,116.1 140.77,116.49 140.53,116.74 U1#10.11 ; U1#9.11 102.11,148.86 102.36,148.61 102.36,148.23 102.1,147.97 89.15,147.97 88.39,148.74 H8#4.1 ; H8#14.1 126.8,84.49 127.57,83.73 140.52,83.73 140.77,83.98 140.77,84.36 140.53,84.61 U1#14.11
LDO_5V: length 19.9
  Top Layer w1: U2.3 54.16,273.79 54.11,273.74 ; H3#4.1 39.34,273.74 U2#3.3 ; U2#2.3 68.89,273.79 H3#2.1 ; U2#4.3 83.62,273.79 H3#3.1
LED_GREEN: length 414.1
  Top Layer w0.254: U1#30.5 49.9,184.23 49.34,184.8 49.34,187.97 48.83,188.48 H5#28.1 ; U1#24.5 49.9,119.98 49.34,120.55 49.34,123.72 48.83,124.23 H5#23.1 ; U1#23.5 11.49,216.36 10.92,216.92 10.92,220.1 10.41,220.61 H5#26.1 ; U1#18.5 11.49,152.11 10.92,152.67 10.92,155.85 10.41,156.36 H5#18.1 ; H5#12.1 125.66,156.36 126.17,155.85 126.17,152.67 126.73,152.11 U1#17.5 ; H5#11.1 125.66,220.61 126.17,220.1 126.17,216.92 126.73,216.36 U1#13.5 ; H5#17.1 10.41,188.48 10.92,187.97 10.92,184.8 11.49,184.23 U1#31.5 ; H5#7.1 87.25,59.98 87.75,59.48 87.75,56.3 88.32,55.74 U1#3.5 ; U1#10.5 126.73,119.98 126.17,120.55 126.17,123.72 125.66,124.23 H5#9.1 ; U1#4.5 88.32,23.61 87.75,24.18 87.75,27.35 87.25,27.86 H5#2.1 ; U1#29.5 49.9,248.48 49.34,249.05 49.34,252.22 48.83,252.73 H5#31.1 ; H5.1 87.25,124.23 87.75,123.72 87.75,120.55 88.32,119.98 U1#2.5 ; H5#30.1 48.83,59.98 49.34,59.48 49.34,56.3 49.9,55.74 U1#25.5 ; H5#21.1 10.41,59.98 10.92,59.48 10.92,56.3 11.49,55.74 U1#21.5 ; H5#22.1 10.41,124.23 10.92,123.72 10.92,120.55 11.49,119.98 U1#22.5 ; 133.46,87.86 126.73,87.86 126.17,88.42 126.17,91.6 125.66,92.11 H5#14.1 ; U1#5.5 88.32,216.36 87.75,216.92 87.75,220.1 87.25,220.61 H5#3.1 ; H5#20.1 10.41,92.11 10.92,91.6 10.92,88.42 11.49,87.86 18.21,87.86 ; U1#27.5 49.9,216.36 49.34,216.92 49.34,220.1 48.83,220.61 H5#25.1 ; 95.04,87.86 88.32,87.86 87.75,88.42 87.75,91.6 87.25,92.11 H5#6.1 ; H5#19.1 10.41,27.86 10.92,27.35 10.92,24.18 11.49,23.61 U1#19.5 ; H5#32.1 10.41,252.73 10.92,252.22 10.92,249.05 11.49,248.48 U1.5 ; H5#4.1 87.25,156.36 87.75,155.85 87.75,152.67 88.32,152.11 U1#9.5 ; H5#24.1 48.83,27.86 49.34,27.35 49.34,24.18 49.9,23.61 U1#26.5 ; H5#5.1 87.25,188.48 87.75,187.97 87.75,184.8 88.32,184.23 U1#8.5 ; 56.63,87.86 49.9,87.86 49.34,88.42 49.34,91.6 48.83,92.11 H5#29.1 ; H5#13.1 125.66,188.48 126.17,187.97 126.17,184.8 126.73,184.23 U1#16.5 ; H5#15.1 125.66,59.98 126.17,59.48 126.17,56.3 126.73,55.74 U1#11.5 ; U1#15.5 126.73,248.48 126.17,249.05 126.17,252.22 125.66,252.73 H5#16.1 ; H5#8.1 87.25,252.73 87.75,252.22 87.75,249.05 88.32,248.48 U1#7.5 ; U1#12.5 126.73,23.61 126.17,24.18 126.17,27.35 125.66,27.86 H5#10.1 ; U1#32.5 49.9,152.11 49.34,152.67 49.34,155.85 48.83,156.36 H5#27.1